# Altium schematic sheet Blockschaltbild.SchDoc: Ultra Low Power Wake Up Receiver
size A3; Date: 11.11.2019; Author: Cédric Renda; CompanyName: HSR; DrawnBy: Cédric Renda; Organization: HSR; Revision: Version1; SheetNumber: 1
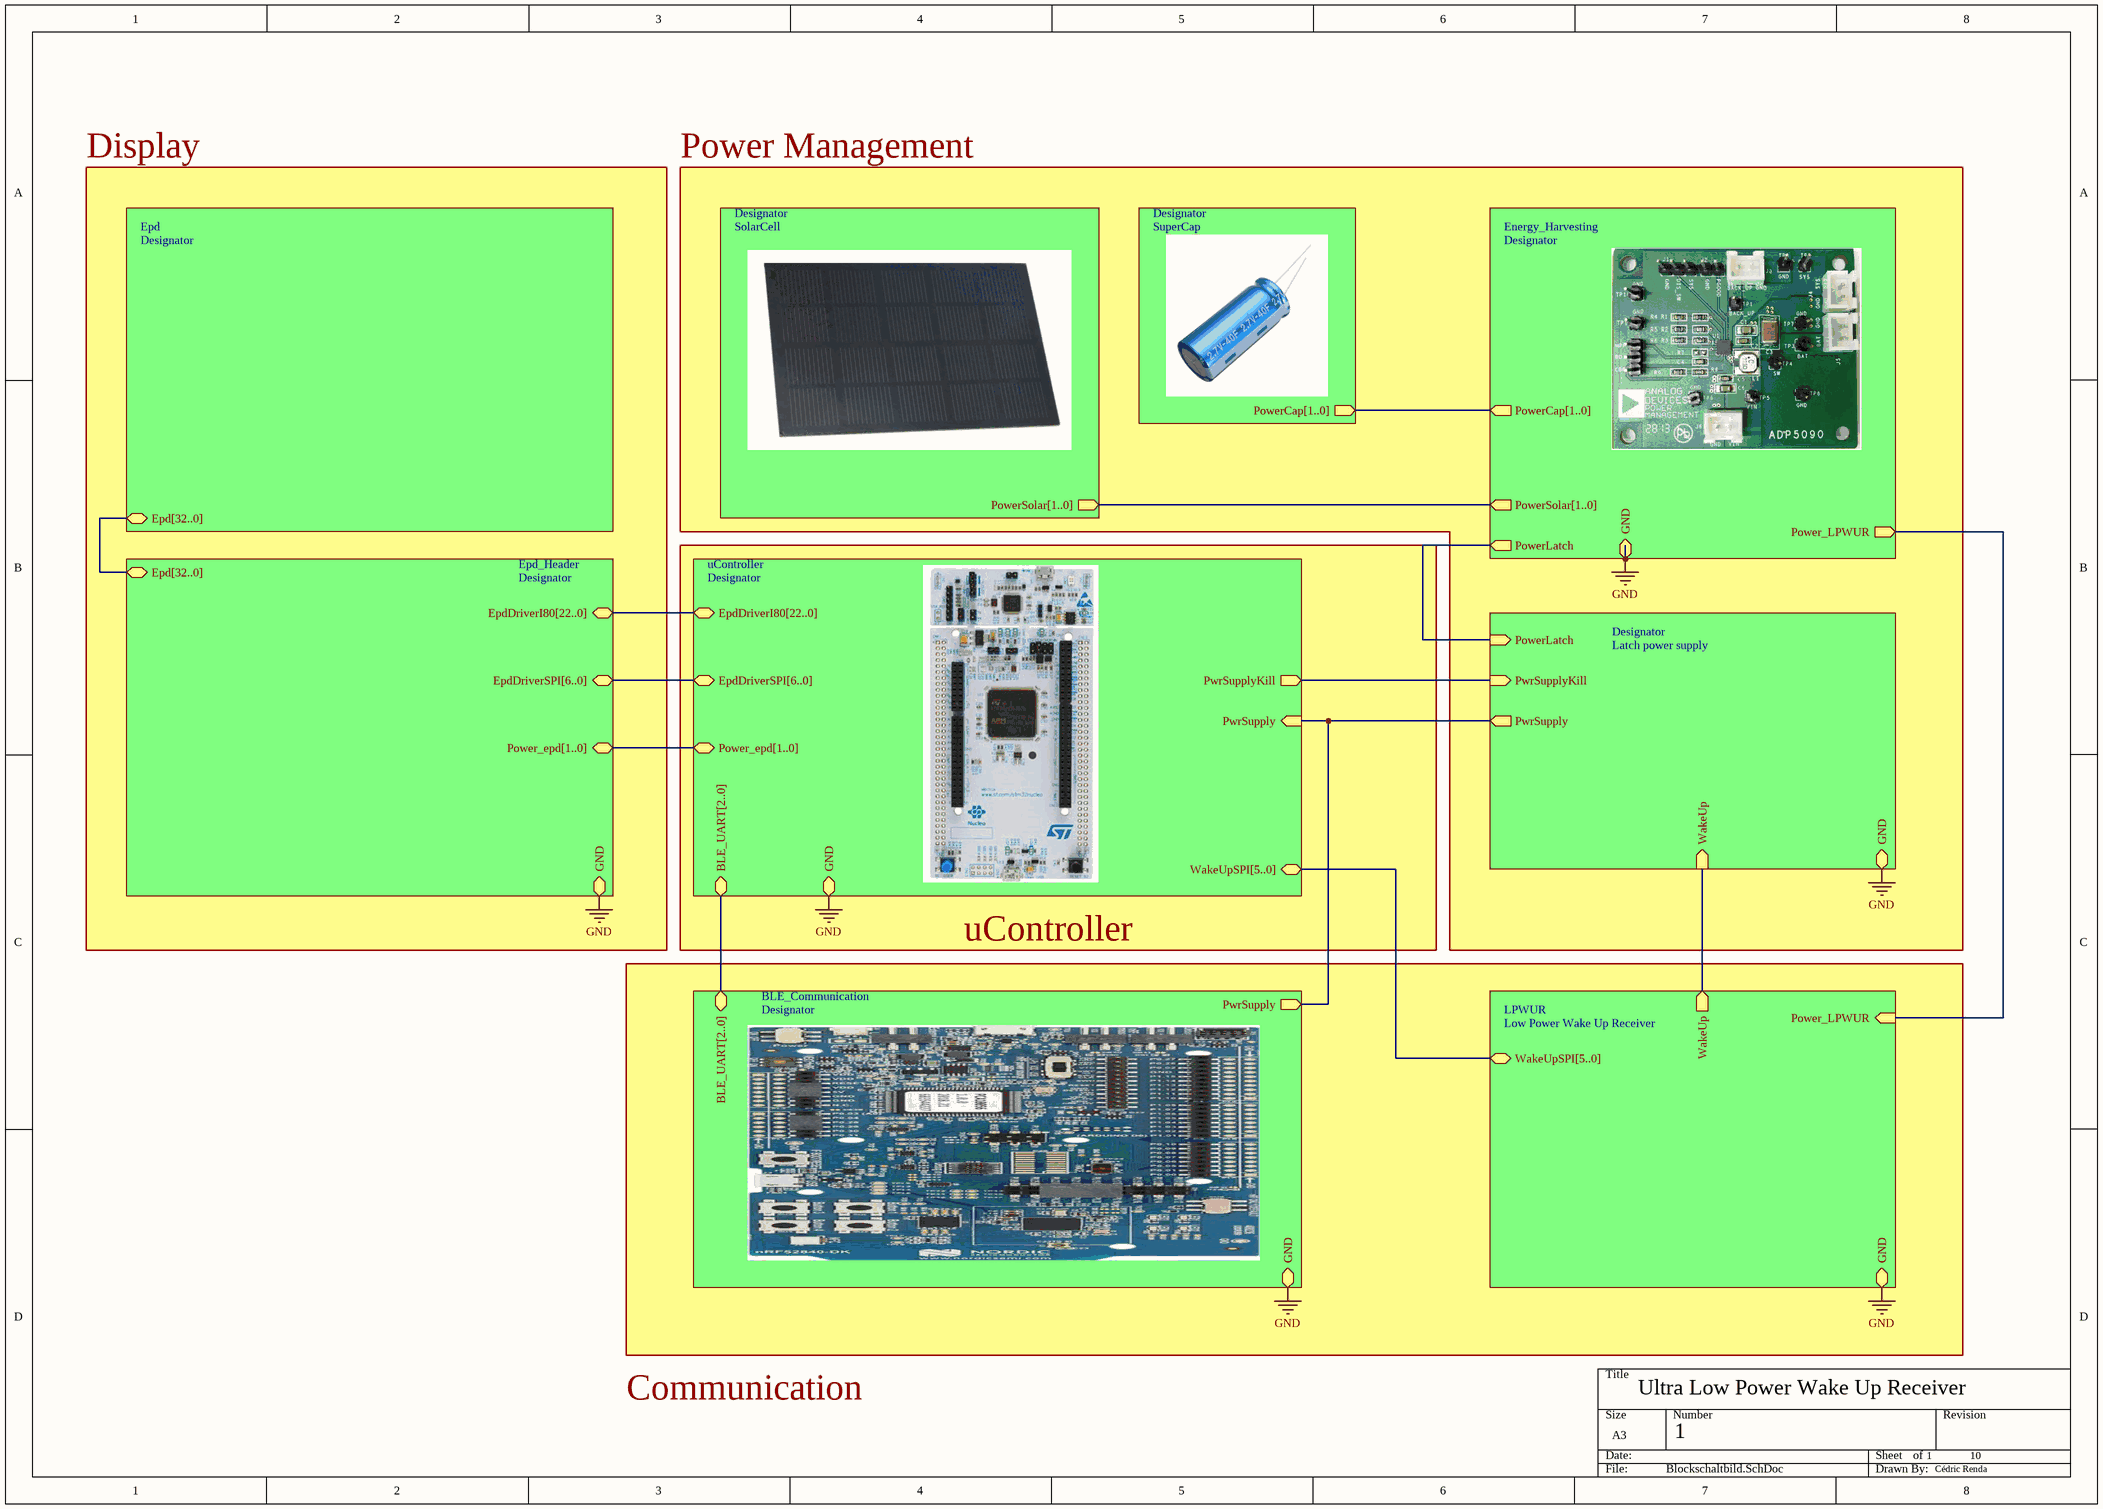
[diagram p0: Blockschaltbild.SchDoc]

## Sub-sheets
Designator = Epd_Header: GND (bidir), Power_epd[1..0] (bidir), EpdDriverI80[22..0] (bidir), EpdDriverSPI[6..0] (bidir), Epd[32..0] (bidir)
Designator = uController: Power_epd[1..0] (bidir), GND (bidir), EpdDriverI80[22..0] (bidir), BLE_UART[2..0] (bidir), EpdDriverSPI[6..0] (bidir), PwrSupplyKill (out), WakeUpSPI[5..0] (bidir), PwrSupply (in)
Designator = BLE_Communication: GND (bidir), BLE_UART[2..0] (bidir), PwrSupply (out)
Designator = Energy_Harvesting: Power_LPWUR (out), GND (bidir), PowerCap[1..0] (out), PowerSolar[1..0] (out), PowerLatch (out)
Designator = Epd: Epd[32..0] (bidir)
Designator = SolarCell: PowerSolar[1..0] (out)
Designator = SuperCap: PowerCap[1..0] (out)
Designator = Latch power supply: PwrSupplyKill (in), PwrSupply (out), GND (bidir), PowerLatch (in), WakeUp (in)
Low Power Wake Up Receiver = LPWUR: WakeUpSPI[5..0] (bidir), Power_LPWUR (in), GND (bidir), WakeUp (out)

## Nets
GND: sheet Designator/GND, sheet Designator/GND, sheet Designator/GND, sheet Designator/GND, sheet Low Power Wake Up Receiver/GND, sheet Designator/GND
(unnamed): sheet Designator/PwrSupplyKill, sheet Designator/PwrSupplyKill
(unnamed): sheet Designator/PwrSupply, sheet Designator/PwrSupply, sheet Designator/PwrSupply
(unnamed): sheet Designator/Power_LPWUR, sheet Low Power Wake Up Receiver/Power_LPWUR
(unnamed): sheet Designator/PowerLatch, sheet Designator/PowerLatch
(unnamed): sheet Low Power Wake Up Receiver/WakeUp, sheet Designator/WakeUp

## Buses and harness runs
bus sheet Designator/WakeUpSPI[5..0] = sheet Low Power Wake Up Receiver/WakeUpSPI[5..0]

## Notes on the sheet
- Display
- Power Management
- uController
- Ultra Low Power Wake Up Receiver
- Communication
- 1
- 10
- Cédric Renda